# Altium schematic sheet 0224_GPU POWER_ GROUND.SchDoc (continued)
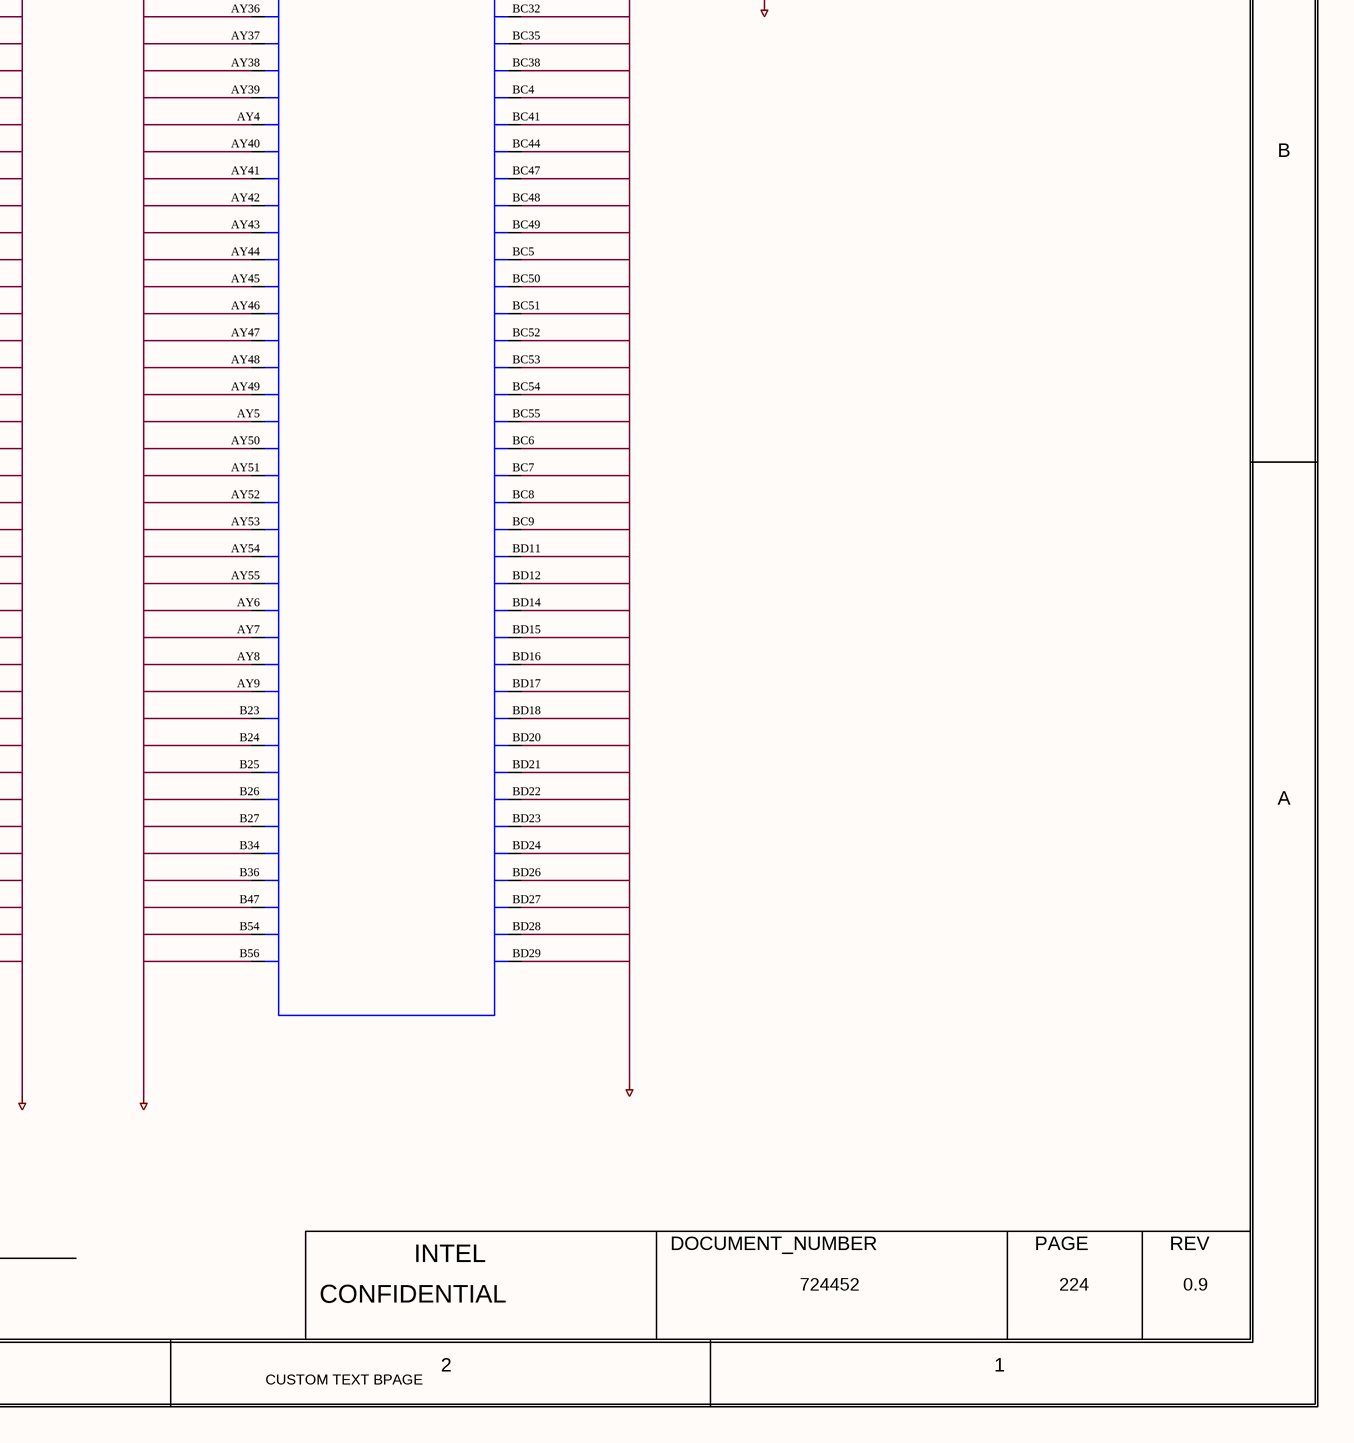
[diagram p5: 0224_GPU POWER_ GROUND.SchDoc, bottom right]

## Parts
U10000  PART_NUMBER: LPID7250  PACK_TYPE: BGA  MATERIAL: IC  FP_TECH: LPDB  [CLPDB_BGA2660_DG2_SVC_512_LP7250_MA]  (hidden comment: DG2_IP_NB_SKU1_SKU2_SKU3_EXT)  (parts 29,30,31,32,33,34,35 of 36)

## Nets
GND: U10000.A4(VSS_798) U10000.A6(VSS_807) U10000.A7(VSS_808) U10000.A9(VSS_809) U10000.A11(VSS_783) U10000.A13(VSS_784) U10000.A15(VSS_785) U10000.A17(VSS_786) U10000.A19(VSS_787) U10000.A21(VSS_788) U10000.A23(VSS_789) U10000.A25(VSS_790) U10000.A27(VSS_791) U10000.A28(VSS_792) U10000.A30(VSS_793) U10000.A32(VSS_794) U10000.A34(VSS_795) U10000.A36(VSS_796) U10000.A39(VSS_797) U10000.A41(VSS_799) U10000.A43(VSS_800) U10000.A45(VSS_801) U10000.A47(VSS_802) U10000.A48(VSS_803) U10000.A50(VSS_804) U10000.A52(VSS_805) U10000.A54(VSS_806) U10000.AA7(VSS_835) U10000.AA11(VSS_810) U10000.AA18(VSS_811) U10000.AA19(VSS_812) U10000.AA20(VSS_813) U10000.AA21(VSS_814) U10000.AA22(VSS_815) U10000.AA23(VSS_816) U10000.AA24(VSS_817) U10000.AA25(VSS_818) U10000.AA26(VSS_819) U10000.AA27(VSS_820) U10000.AA28(VSS_821) U10000.AA29(VSS_822) U10000.AA30(VSS_823) U10000.AA31(VSS_824) U10000.AA32(VSS_825) U10000.AA33(VSS_826) U10000.AA34(VSS_827) U10000.AA35(VSS_828) U10000.AA36(VSS_829) U10000.AA37(VSS_830) U10000.AA38(VSS_831) U10000.AA39(VSS_832) U10000.AA40(VSS_833) U10000.AA47(VSS_834) U10000.AB3(VSS_837) U10000.AB7(VSS_841) U10000.AB11(VSS_836) U10000.AB47(VSS_838) U10000.AB51(VSS_839) U10000.AB53(VSS_840) U10000.AC3(VSS_843) U10000.AC4(VSS_844) U10000.AC5(VSS_847) U10000.AC6(VSS_854) U10000.AC7(VSS_855) U10000.AC8(VSS_856) U10000.AC9(VSS_857) U10000.AC10(VSS_842) U10000.AC48(VSS_845) U10000.AC49(VSS_846) U10000.AC50(VSS_848) U10000.AC51(VSS_849) U10000.AC52(VSS_850) U10000.AC53(VSS_851) U10000.AC54(VSS_852) U10000.AC55(VSS_853) U10000.AD5(VSS_883) U10000.AD7(VSS_885) U10000.AD11(VSS_858) U10000.AD18(VSS_859) U10000.AD19(VSS_860) U10000.AD20(VSS_861) U10000.AD21(VSS_862) U10000.AD22(VSS_863) U10000.AD23(VSS_864) U10000.AD24(VSS_865) U10000.AD25(VSS_866) U10000.AD26(VSS_867) U10000.AD27(VSS_868) U10000.AD28(VSS_869) U10000.AD29(VSS_870) U10000.AD30(VSS_871) U10000.AD31(VSS_872) U10000.AD32(VSS_873) U10000.AD33(VSS_874) U10000.AD34(VSS_875) U10000.AD35(VSS_876) U10000.AD36(VSS_877) U10000.AD37(VSS_878) U10000.AD38(VSS_879) U10000.AD39(VSS_880) U10000.AD40(VSS_881) U10000.AD47(VSS_882) U10000.AD51(VSS_884) U10000.AE11(VSS_886) U10000.AE47(VSS_887) U10000.AE51(VSS_888) U10000.AF3(VSS_890) U10000.AF4(VSS_891) U10000.AF5(VSS_894) U10000.AF6(VSS_901) U10000.AF7(VSS_902) U10000.AF8(VSS_903) U10000.AF9(VSS_904) U10000.AF10(VSS_889) U10000.AF48(VSS_892) U10000.AF49(VSS_893) U10000.AF50(VSS_895) U10000.AF51(VSS_896) U10000.AF52(VSS_897) U10000.AF53(VSS_898) U10000.AF54(VSS_899) U10000.AF55(VSS_900) U10000.AG7(VSS_930) U10000.AG11(VSS_905) U10000.AG18(VSS_906) U10000.AG19(VSS_907) U10000.AG20(VSS_908) U10000.AG21(VSS_909) U10000.AG22(VSS_910) U10000.AG23(VSS_911) U10000.AG24(VSS_912) U10000.AG25(VSS_913) U10000.AG26(VSS_914) U10000.AG27(VSS_915) U10000.AG28(VSS_916) U10000.AG29(VSS_917) U10000.AG30(VSS_918) U10000.AG31(VSS_919) U10000.AG32(VSS_920) U10000.AG33(VSS_921) U10000.AG34(VSS_922) U10000.AG35(VSS_923) U10000.AG36(VSS_924) U10000.AG37(VSS_925) U10000.AG38(VSS_926) U10000.AG39(VSS_927) U10000.AG40(VSS_928) U10000.AG47(VSS_929) U10000.AH7(VSS_634) U10000.AH11(VSS_931) U10000.AH47(VSS_932) U10000.AH51(VSS_633) U10000.AJ3(VSS_637) U10000.AJ4(VSS_638) U10000.AJ5(VSS_642) U10000.AJ6(VSS_650) U10000.AJ7(VSS_651) U10000.AJ8(VSS_652) U10000.AJ9(VSS_653) U10000.AJ10(VSS_635) U10000.AJ11(VSS_636) U10000.AJ47(VSS_639) U10000.AJ48(VSS_640) U10000.AJ49(VSS_641) U10000.AJ50(VSS_643) U10000.AJ51(VSS_644) U10000.AJ52(VSS_645) U10000.AJ53(VSS_646) U10000.AJ54(VSS_647) U10000.AJ55(VSS_648) U10000.AJ56(VSS_649) U10000.AK17(VSS_654) U10000.AK20(VSS_655) U10000.AK23(VSS_656) U10000.AK26(VSS_657) U10000.AK29(VSS_658) U10000.AK32(VSS_659) U10000.AK35(VSS_660) U10000.AK38(VSS_661) U10000.AK41(VSS_662) U10000.AL2(VSS_664) U10000.AL3(VSS_665) U10000.AL4(VSS_666) U10000.AL5(VSS_669) U10000.AL6(VSS_676) U10000.AL7(VSS_677) U10000.AL8(VSS_678) U10000.AL9(VSS_679) U10000.AL10(VSS_663) U10000.AL48(VSS_667) U10000.AL49(VSS_668) U10000.AL50(VSS_670) U10000.AL51(VSS_671) U10000.AL52(VSS_672) U10000.AL53(VSS_673) U10000.AL54(VSS_674) U10000.AL55(VSS_675) U10000.AM7(VSS_684) U10000.AM11(VSS_680) U10000.AM47(VSS_681) U10000.AM51(VSS_682) U10000.AM54(VSS_683) U10000.AN11(VSS_685) U10000.AN13(VSS_686) U10000.AN45(VSS_687) U10000.AN47(VSS_688) U10000.AN51(VSS_689) U10000.AP3(VSS_693) U10000.AP4(VSS_695) U10000.AP5(VSS_699) U10000.AP6(VSS_706) U10000.AP7(VSS_707) U10000.AP8(VSS_708) U10000.AP9(VSS_709) U10000.AP10(VSS_690) U10000.AP14(VSS_691) U10000.AP25(VSS_692) U10000.AP32(VSS_694) U10000.AP43(VSS_696) U10000.AP48(VSS_697) U10000.AP49(VSS_698) U10000.AP50(VSS_700) U10000.AP51(VSS_701) U10000.AP52(VSS_702) U10000.AP53(VSS_703) U10000.AP54(VSS_704) U10000.AP55(VSS_705) U10000.AR7(VSS_716) U10000.AR11(VSS_710) U10000.AR15(VSS_711) U10000.AR26(VSS_712) U10000.AR32(VSS_713) U10000.AR43(VSS_714) U10000.AR47(VSS_715) U10000.AT3(VSS_721) U10000.AT7(VSS_727) U10000.AT11(VSS_717) U10000.AT15(VSS_718) U10000.AT26(VSS_719) U10000.AT29(VSS_720) U10000.AT32(VSS_722) U10000.AT43(VSS_723) U10000.AT47(VSS_724) U10000.AT51(VSS_725) U10000.AT53(VSS_726) U10000.AU3(VSS_744) U10000.AU4(VSS_753) U10000.AU5(VSS_762) U10000.AU6(VSS_769) U10000.AU7(VSS_770) U10000.AU8(VSS_771) U10000.AU9(VSS_772) U10000.AU10(VSS_728) U10000.AU11(VSS_729) U10000.AU14(VSS_730) U10000.AU15(VSS_731) U10000.AU16(VSS_732) U10000.AU17(VSS_733) U10000.AU18(VSS_734) U10000.AU19(VSS_735) U10000.AU20(VSS_736) U10000.AU21(VSS_737) U10000.AU22(VSS_738) U10000.AU23(VSS_739) U10000.AU24(VSS_740) U10000.AU25(VSS_741) U10000.AU26(VSS_742) U10000.AU29(VSS_743) U10000.AU32(VSS_745) U10000.AU33(VSS_746) U10000.AU34(VSS_747) U10000.AU35(VSS_748) U10000.AU36(VSS_749) U10000.AU37(VSS_750) U10000.AU38(VSS_751) U10000.AU39(VSS_752) U10000.AU40(VSS_754) U10000.AU41(VSS_755) U10000.AU42(VSS_756) U10000.AU43(VSS_757) U10000.AU44(VSS_758) U10000.AU47(VSS_759) U10000.AU48(VSS_760) U10000.AU49(VSS_761) U10000.AU50(VSS_763) U10000.AU51(VSS_764) U10000.AU52(VSS_765) U10000.AU53(VSS_766) U10000.AU54(VSS_767) U10000.AU55(VSS_768) U10000.AV5(VSS_782) U10000.AV7(VSS_484) U10000.AV11(VSS_773) U10000.AV14(VSS_774) U10000.AV19(VSS_775) U10000.AV24(VSS_776) U10000.AV29(VSS_777) U10000.AV34(VSS_778) U10000.AV39(VSS_779) U10000.AV44(VSS_780) U10000.AV47(VSS_781) U10000.AV51(VSS_483) U10000.AW11(VSS_485) U10000.AW14(VSS_486) U10000.AW19(VSS_487) U10000.AW24(VSS_488) U10000.AW29(VSS_489) U10000.AW34(VSS_490) U10000.AW39(VSS_491) U10000.AW44(VSS_492) U10000.AW47(VSS_493) U10000.AW51(VSS_494) U10000.AY3(VSS_515) U10000.AY4(VSS_526) U10000.AY5(VSS_537) U10000.AY6(VSS_544) U10000.AY7(VSS_545) U10000.AY8(VSS_546) U10000.AY9(VSS_547) U10000.AY10(VSS_495) U10000.AY11(VSS_496) U10000.AY12(VSS_497) U10000.AY13(VSS_498) U10000.AY14(VSS_499) U10000.AY15(VSS_500) U10000.AY16(VSS_501) U10000.AY17(VSS_502) U10000.AY18(VSS_503) U10000.AY19(VSS_504) U10000.AY20(VSS_505) U10000.AY21(VSS_506) U10000.AY22(VSS_507) U10000.AY23(VSS_508) U10000.AY24(VSS_509) U10000.AY25(VSS_510) U10000.AY26(VSS_511) U10000.AY27(VSS_512) U10000.AY28(VSS_513) U10000.AY29(VSS_514) U10000.AY30(VSS_516) U10000.AY31(VSS_517) U10000.AY32(VSS_518) U10000.AY33(VSS_519) U10000.AY34(VSS_520) U10000.AY35(VSS_521) U10000.AY36(VSS_522) U10000.AY37(VSS_523) U10000.AY38(VSS_524) U10000.AY39(VSS_525) U10000.AY40(VSS_527) U10000.AY41(VSS_528) U10000.AY42(VSS_529) U10000.AY43(VSS_530) U10000.AY44(VSS_531) U10000.AY45(VSS_532) U10000.AY46(VSS_533) U10000.AY47(VSS_534) U10000.AY48(VSS_535) U10000.AY49(VSS_536) U10000.AY50(VSS_538) U10000.AY51(VSS_539) U10000.AY52(VSS_540) U10000.AY53(VSS_541) U10000.AY54(VSS_542) U10000.AY55(VSS_543) U10000.B6(VSS_558) U10000.B23(VSS_548) U10000.B24(VSS_549) U10000.B25(VSS_550) U10000.B26(VSS_551) U10000.B27(VSS_552) U10000.B34(VSS_553) U10000.B36(VSS_554) U10000.B47(VSS_555) U10000.B54(VSS_556) U10000.B56(VSS_557) U10000.BA7(VSS_572) U10000.BA11(VSS_559) U10000.BA14(VSS_560) U10000.BA17(VSS_561) U10000.BA20(VSS_562) U10000.BA23(VSS_563) U10000.BA26(VSS_564) U10000.BA29(VSS_565) U10000.BA32(VSS_566) U10000.BA35(VSS_567) U10000.BA38(VSS_568) U10000.BA41(VSS_569) U10000.BA44(VSS_570) U10000.BA47(VSS_571) U10000.BB7(VSS_587) U10000.BB11(VSS_573) U10000.BB14(VSS_574) U10000.BB17(VSS_575) U10000.BB20(VSS_576) U10000.BB23(VSS_577) U10000.BB26(VSS_578) U10000.BB29(VSS_579) U10000.BB32(VSS_580) U10000.BB35(VSS_581) U10000.BB38(VSS_582) U10000.BB41(VSS_583) U10000.BB44(VSS_584) U10000.BB47(VSS_585) U10000.BB51(VSS_586) U10000.BC3(VSS_596) U10000.BC4(VSS_600) U10000.BC5(VSS_606) U10000.BC6(VSS_613) U10000.BC7(VSS_614) U10000.BC8(VSS_615) U10000.BC9(VSS_616) U10000.BC10(VSS_588) U10000.BC11(VSS_589) U10000.BC14(VSS_590) U10000.BC17(VSS_591) U10000.BC20(VSS_592) U10000.BC23(VSS_593) U10000.BC26(VSS_594) U10000.BC29(VSS_595) U10000.BC32(VSS_597) U10000.BC35(VSS_598) U10000.BC38(VSS_599) U10000.BC41(VSS_601) U10000.BC44(VSS_602) U10000.BC47(VSS_603) U10000.BC48(VSS_604) U10000.BC49(VSS_605) U10000.BC50(VSS_607) U10000.BC51(VSS_608) U10000.BC52(VSS_609) U10000.BC53(VSS_610) U10000.BC54(VSS_611) U10000.BC55(VSS_612) U10000.BD7(VSS_350) U10000.BD11(VSS_617) U10000.BD12(VSS_618) U10000.BD14(VSS_619) U10000.BD15(VSS_620) U10000.BD16(VSS_621) U10000.BD17(VSS_622) U10000.BD18(VSS_623) U10000.BD20(VSS_624) U10000.BD21(VSS_625) U10000.BD22(VSS_626) U10000.BD23(VSS_627) U10000.BD24(VSS_628) U10000.BD26(VSS_629) U10000.BD27(VSS_630) U10000.BD28(VSS_631) U10000.BD29(VSS_632) U10000.BD30(VSS_333) U10000.BD32(VSS_334) U10000.BD33(VSS_335) U10000.BD34(VSS_336) U10000.BD35(VSS_337) U10000.BD36(VSS_338) U10000.BD38(VSS_339) U10000.BD39(VSS_340) U10000.BD40(VSS_341) U10000.BD41(VSS_342) U10000.BD42(VSS_343) U10000.BD44(VSS_344) U10000.BD45(VSS_345) U10000.BD46(VSS_346) U10000.BD47(VSS_347) U10000.BD51(VSS_348) U10000.BD54(VSS_349) U10000.BE11(VSS_351) U10000.BE14(VSS_352) U10000.BE17(VSS_353) U10000.BE20(VSS_354) U10000.BE23(VSS_355) U10000.BE26(VSS_356) U10000.BE29(VSS_357) U10000.BE32(VSS_358) U10000.BE35(VSS_359) U10000.BE38(VSS_360) U10000.BE41(VSS_361) U10000.BE44(VSS_362) U10000.BE47(VSS_363) U10000.BE51(VSS_364) U10000.BF3(VSS_375) U10000.BF4(VSS_380) U10000.BF5(VSS_386) U10000.BF6(VSS_393) U10000.BF7(VSS_394) U10000.BF8(VSS_395) U10000.BF9(VSS_396) U10000.BF10(VSS_365) U10000.BF11(VSS_366) U10000.BF12(VSS_367) U10000.BF14(VSS_368) U10000.BF17(VSS_369) U10000.BF20(VSS_370) U10000.BF23(VSS_371) U10000.BF24(VSS_372) U10000.BF26(VSS_373) U10000.BF29(VSS_374) U10000.BF32(VSS_376) U10000.BF35(VSS_377) U10000.BF36(VSS_378) U10000.BF38(VSS_379) U10000.BF41(VSS_381) U10000.BF44(VSS_382) U10000.BF47(VSS_383) U10000.BF48(VSS_384) U10000.BF49(VSS_385) U10000.BF50(VSS_387) U10000.BF51(VSS_388) U10000.BF52(VSS_389) U10000.BF53(VSS_390) U10000.BF54(VSS_391) U10000.BF55(VSS_392) U10000.BG1(VSS_397) U10000.BG7(VSS_413) U10000.BG11(VSS_398) U10000.BG14(VSS_399) U10000.BG17(VSS_400) U10000.BG20(VSS_401) U10000.BG23(VSS_402) U10000.BG26(VSS_403) U10000.BG29(VSS_404) U10000.BG32(VSS_405) U10000.BG35(VSS_406) U10000.BG38(VSS_407) U10000.BG40(VSS_408) U10000.BG41(VSS_409) U10000.BG44(VSS_410) U10000.BG47(VSS_411) U10000.BG57(VSS_412) U10000.BH1(VSS_414) U10000.BH2(VSS_419) U10000.BH7(VSS_433) U10000.BH10(VSS_415) U10000.BH11(VSS_416) U10000.BH14(VSS_417) U10000.BH17(VSS_418) U10000.BH20(VSS_420) U10000.BH22(VSS_421) U10000.BH23(VSS_422) U10000.BH26(VSS_423) U10000.BH29(VSS_424) U10000.BH32(VSS_425) U10000.BH35(VSS_426) U10000.BH38(VSS_427) U10000.BH41(VSS_428) U10000.BH44(VSS_429) U10000.BH47(VSS_430) U10000.BH51(VSS_431) U10000.BH53(VSS_432) U10000.BJ2(VSS_435) U10000.BJ3(VSS_436) U10000.BJ4(VSS_437) U10000.BJ5(VSS_440) U10000.BJ6(VSS_448) U10000.BJ7(VSS_449) U10000.BJ8(VSS_450) U10000.BJ9(VSS_451) U10000.BJ10(VSS_434) U10000.BJ48(VSS_438) U10000.BJ49(VSS_439) U10000.BJ50(VSS_441) U10000.BJ51(VSS_442) U10000.BJ52(VSS_443) U10000.BJ53(VSS_444) U10000.BJ54(VSS_445) U10000.BJ55(VSS_446) U10000.BJ56(VSS_447) U10000.BK4(VSS_453) U10000.BK7(VSS_457) U10000.BK10(VSS_452) U10000.BK48(VSS_454) U10000.BK54(VSS_455) U10000.BK55(VSS_456) U10000.C6(VSS_481) U10000.C8(VSS_482) U10000.C10(VSS_458) U10000.C12(VSS_459) U10000.C14(VSS_460) U10000.C16(VSS_461) U10000.C18(VSS_462) U10000.C20(VSS_463) U10000.C22(VSS_464) U10000.C23(VSS_465) U10000.C25(VSS_466) U10000.C27(VSS_467) U10000.C29(VSS_468) U10000.C31(VSS_469) U10000.C33(VSS_470) U10000.C34(VSS_471) U10000.C36(VSS_472) U10000.C38(VSS_473) U10000.C40(VSS_474) U10000.C47(VSS_475) U10000.C49(VSS_476) U10000.C51(VSS_477) U10000.C53(VSS_478) U10000.C54(VSS_479) U10000.C57(VSS_480) U10000.D2(VSS_193) U10000.D4(VSS_208) U10000.D6(VSS_225) U10000.D7(VSS_226) U10000.D8(VSS_227) U10000.D9(VSS_228) U10000.D10(VSS_183) U10000.D11(VSS_184) U10000.D12(VSS_185) U10000.D13(VSS_186) U10000.D14(VSS_187) U10000.D15(VSS_188) U10000.D16(VSS_189) U10000.D17(VSS_190) U10000.D18(VSS_191) U10000.D19(VSS_192) U10000.D20(VSS_194) U10000.D21(VSS_195) U10000.D22(VSS_196) U10000.D23(VSS_197) U10000.D25(VSS_198) U10000.D27(VSS_199) U10000.D28(VSS_200) U10000.D29(VSS_201) U10000.D30(VSS_202) U10000.D31(VSS_203) U10000.D32(VSS_204) U10000.D33(VSS_205) U10000.D37(VSS_206) U10000.D39(VSS_207) U10000.D41(VSS_209) U10000.D43(VSS_210) U10000.D44(VSS_211) U10000.D45(VSS_212) U10000.D46(VSS_213) U10000.D47(VSS_214) U10000.D48(VSS_215) U10000.D49(VSS_216) U10000.D50(VSS_217) U10000.D51(VSS_218) U10000.D52(VSS_219) U10000.D53(VSS_220) U10000.D54(VSS_221) U10000.D55(VSS_222) U10000.D56(VSS_223) U10000.D57(VSS_224) U10000.E6(VSS_250) U10000.E8(VSS_251) U10000.E10(VSS_229) U10000.E12(VSS_230) U10000.E14(VSS_231) U10000.E16(VSS_232) U10000.E18(VSS_233) U10000.E20(VSS_234) U10000.E22(VSS_235) U10000.E23(VSS_236) U10000.E24(VSS_237) U10000.E25(VSS_238) U10000.E26(VSS_239) U10000.E27(VSS_240) U10000.E29(VSS_241) U10000.E43(VSS_242) U10000.E45(VSS_243) U10000.E47(VSS_244) U10000.E49(VSS_245) U10000.E50(VSS_246) U10000.E53(VSS_247) U10000.E54(VSS_248) U10000.E57(VSS_249) U10000.F2(VSS_252) U10000.F4(VSS_262) U10000.F6(VSS_269) U10000.F23(VSS_253) U10000.F25(VSS_254) U10000.F27(VSS_255) U10000.F29(VSS_256) U10000.F30(VSS_257) U10000.F32(VSS_258) U10000.F34(VSS_259) U10000.F36(VSS_260) U10000.F38(VSS_261) U10000.F40(VSS_263) U10000.F43(VSS_264) U10000.F50(VSS_265) U10000.F51(VSS_266) U10000.F54(VSS_267) U10000.F55(VSS_268) U10000.G6(VSS_292) U10000.G7(VSS_293) U10000.G9(VSS_294) U10000.G11(VSS_270) U10000.G13(VSS_271) U10000.G15(VSS_272) U10000.G17(VSS_273) U10000.G19(VSS_274) U10000.G21(VSS_275) U10000.G23(VSS_276) U10000.G25(VSS_277) U10000.G27(VSS_278) U10000.G28(VSS_279) U10000.G29(VSS_280) U10000.G31(VSS_281) U10000.G33(VSS_282) U10000.G37(VSS_283) U10000.G43(VSS_284) U10000.G44(VSS_285) U10000.G46(VSS_286) U10000.G48(VSS_287) U10000.G50(VSS_288) U10000.G53(VSS_289) U10000.G54(VSS_290) U10000.G57(VSS_291) U10000.H2(VSS_305) U10000.H3(VSS_312) U10000.H4(VSS_313) U10000.H5(VSS_323) U10000.H6(VSS_328) U10000.H7(VSS_329) U10000.H8(VSS_330) U10000.H9(VSS_331) U10000.H10(VSS_295) U10000.H11(VSS_296) U10000.H12(VSS_297) U10000.H13(VSS_298) U10000.H14(VSS_299) U10000.H15(VSS_300) U10000.H16(VSS_301) U10000.H17(VSS_302) U10000.H18(VSS_303) U10000.H19(VSS_304) U10000.H20(VSS_306) U10000.H21(VSS_307) U10000.H22(VSS_308) U10000.H23(VSS_309) U10000.H26(VSS_310) U10000.H29(VSS_311) U10000.H41(VSS_314) U10000.H42(VSS_315) U10000.H43(VSS_316) U10000.H44(VSS_317) U10000.H45(VSS_318) U10000.H46(VSS_319) U10000.H47(VSS_320) U10000.H48(VSS_321) U10000.H49(VSS_322) U10000.H50(VSS_324) U10000.H51(VSS_325) U10000.H54(VSS_326) U10000.H55(VSS_327) U10000.J15(VSS_332) U10000.J16(VSS_33) U10000.J24(VSS_34) U10000.J25(VSS_35) U10000.J26(VSS_36) U10000.J27(VSS_37) U10000.J28(VSS_38) U10000.J29(VSS_39) U10000.J30(VSS_40) U10000.J31(VSS_41) U10000.J32(VSS_42) U10000.J33(VSS_43) U10000.J34(VSS_44) U10000.J35(VSS_45) U10000.J36(VSS_46) U10000.J37(VSS_47) U10000.J38(VSS_48) U10000.J39(VSS_49) U10000.J40(VSS_50) U10000.J41(VSS_51) U10000.J50(VSS_52) U10000.J53(VSS_53) U10000.J54(VSS_54) U10000.J57(VSS_55) U10000.K16(VSS_56) U10000.K17(VSS_57) U10000.K50(VSS_58) U10000.K51(VSS_59) U10000.K54(VSS_60) U10000.K55(VSS_61) U10000.L17(VSS_62) U10000.L18(VSS_63) U10000.L19(VSS_64) U10000.L51(VSS_65) U10000.L52(VSS_66) U10000.L53(VSS_67) U10000.L54(VSS_68) U10000.L55(VSS_69) U10000.L56(VSS_70) U10000.L57(VSS_71) U10000.M19(VSS_72) U10000.M20(VSS_73) U10000.M21(VSS_74) U10000.M22(VSS_75) U10000.M23(VSS_76) U10000.M24(VSS_77) U10000.M25(VSS_78) U10000.M26(VSS_79) U10000.M27(VSS_80) U10000.M28(VSS_81) U10000.M29(VSS_82) U10000.M30(VSS_83) U10000.M31(VSS_84) U10000.M32(VSS_85) U10000.M33(VSS_86) U10000.M34(VSS_87) U10000.M35(VSS_88) U10000.M36(VSS_89) U10000.M37(VSS_90) U10000.M38(VSS_91) U10000.M39(VSS_92) U10000.M40(VSS_93) U10000.M41(VSS_94) U10000.M42(VSS_95) U10000.M43(VSS_96) U10000.M44(VSS_97) U10000.M45(VSS_98) U10000.M46(VSS_99) U10000.M47(VSS_100) U10000.N47(VSS_101) U10000.P47(VSS_102) U10000.P48(VSS_103) U10000.P49(VSS_104) U10000.P50(VSS_105) U10000.P51(VSS_106) U10000.P52(VSS_107) U10000.P53(VSS_108) U10000.P54(VSS_109) U10000.P55(VSS_110) U10000.P56(VSS_111) U10000.P57(VSS_112) U10000.R16(VSS_113) U10000.R17(VSS_114) U10000.R18(VSS_115) U10000.R19(VSS_116) U10000.R20(VSS_117) U10000.R21(VSS_118) U10000.R22(VSS_119) U10000.R23(VSS_120) U10000.R24(VSS_121) U10000.R25(VSS_122) U10000.R26(VSS_123) U10000.R27(VSS_124) U10000.R28(VSS_125) U10000.R29(VSS_126) U10000.R30(VSS_127) U10000.R31(VSS_128) U10000.R32(VSS_129) U10000.R33(VSS_130) U10000.R34(VSS_131) U10000.R35(VSS_132) U10000.R36(VSS_133) U10000.R37(VSS_134) U10000.R38(VSS_135) U10000.R39(VSS_136) U10000.R40(VSS_137) U10000.R41(VSS_138) U10000.R42(VSS_139) U10000.R47(VSS_140) U10000.T47(VSS_141) U10000.T56(VSS_142) U10000.U2(VSS_145) U10000.U3(VSS_146) U10000.U4(VSS_147) U10000.U5(VSS_151) U10000.U6(VSS_158) U10000.U7(VSS_159) U10000.U8(VSS_160) U10000.U9(VSS_161) U10000.U10(VSS_143) U10000.U11(VSS_144) U10000.U47(VSS_148) U10000.U48(VSS_149) U10000.U49(VSS_150) U10000.U50(VSS_152) U10000.U51(VSS_153) U10000.U52(VSS_154) U10000.U53(VSS_155) U10000.U54(VSS_156) U10000.U55(VSS_157) U10000.V7(VSS_7) U10000.V11(VSS_162) U10000.V18(VSS_163) U10000.V19(VSS_164) U10000.V20(VSS_165) U10000.V21(VSS_166) U10000.V22(VSS_167) U10000.V23(VSS_168) U10000.V24(VSS_169) U10000.V25(VSS_170) U10000.V26(VSS_171) U10000.V27(VSS_172) U10000.V28(VSS_173) U10000.V29(VSS_174) U10000.V30(VSS_175) U10000.V31(VSS_176) U10000.V32(VSS_177) U10000.V33(VSS_178) U10000.V34(VSS_179) U10000.V35(VSS_180) U10000.V36(VSS_181) U10000.V37(VSS_182) U10000.V38(VSS_1) U10000.V39(VSS_2) U10000.V40(VSS_3) U10000.V47(VSS_4) U10000.V51(VSS_5) U10000.V54(VSS_6) U10000.W11(VSS_8) U10000.W47(VSS_9) U10000.W51(VSS_10) U10000.Y3(VSS_15) U10000.Y4(VSS_16) U10000.Y5(VSS_22) U10000.Y6(VSS_29) U10000.Y7(VSS_30) U10000.Y8(VSS_31) U10000.Y9(VSS_32) U10000.Y10(VSS_11) U10000.Y11(VSS_12) U10000.Y12(VSS_13) U10000.Y13(VSS_14) U10000.Y45(VSS_17) U10000.Y46(VSS_18) U10000.Y47(VSS_19) U10000.Y48(VSS_20) U10000.Y49(VSS_21) U10000.Y50(VSS_23) U10000.Y51(VSS_24) U10000.Y52(VSS_25) U10000.Y53(VSS_26) U10000.Y54(VSS_27) U10000.Y55(VSS_28)

## Notes on the sheet
- <XR_PAGE_TITLE>
- 8
- 7
- 6
- 5
- 4
- 3
- 2
- 1
- GPU POWER: GROUND
- MODULE REV DETAILS
- MODULE NAME
- REV
- DATE
- D
- C
- B
- A
- BPAGE DRAWING
- INTEL
- DOCUMENT_NUMBER
- PAGE
- Wed May 11 04:03:02 2022
- h55_dg2_2dpc.GND
- CONFIDENTIAL
- 724452
- 224
- 0.9
- CUSTOM TEXT BPAGE
- (in symbol DG2_IP_NB_SKU1_SKU2_SKU3_EXT, part 29) 29 OF 36
- (in symbol DG2_IP_NB_SKU1_SKU2_SKU3_EXT, part 30) 30 OF 36
- (in symbol DG2_IP_NB_SKU1_SKU2_SKU3_EXT, part 31) 31 OF 36
- (in symbol DG2_IP_NB_SKU1_SKU2_SKU3_EXT, part 32) 32 OF 36
- (in symbol DG2_IP_NB_SKU1_SKU2_SKU3_EXT, part 33) 33 OF 36
- (in symbol DG2_IP_NB_SKU1_SKU2_SKU3_EXT, part 34) 34 OF 36
- (in symbol DG2_IP_NB_SKU1_SKU2_SKU3_EXT, part 35) 35 OF 36

## Library data of the parts
U10000 = DG2_IP_NB_SKU1_SKU2_SKU3_EXT: MANUF: INTEL CORP; CDS_PHYS_PART_NAME: DG2_IP_NB_SKU1_SKU2_SKU3_EXT_BGA-LPID7250,IC,DG2_IP_NB_SKU1_SKUA; CDS_LMAN_SYM_OUTLINE: -300,850,300,-800; OriginalSymbolOrigin: (-325,850); CaptureCellPackProp: DG2_IP_NB_SKU1_SKU2_SKU3_EXTAC; XY: (-7200,3550); VER: 29; ROT: 0; PHYS_PAGE: 224; MFG_PN: NONE; LOCATION: U10000; DRAWING: @RVP1_ADL_SB_ADP_S_DDR5_SODIMM_2DPC_LIB.H55_DG2_2DPC(SCH_1):PAGE395; CDS_LIB: rvp1_adl_sb_adp_s_ddr5_sodimm_2dpc_lib; BMAP_REV: 1.0; PCB Footprint: CLPDB_BGA2660_DG2_SVC_512_LP7250_MA; SEC_TYPE: BGA; CHIPS_PART_NAME: DG2_IP_NB_SKU1_SKU2_SKU3_EXT; CDS_PART_NAME: DG2_IP_NB_SKU1_SKU2_SKU3_EXT_BGA-LPID7250,IC,DG2_IP_NB_SKU1_SKUA; CDS_LOCATION: U10000